# Altium schematic sheet FPGA.SchDoc
size 1188 x 840 mm
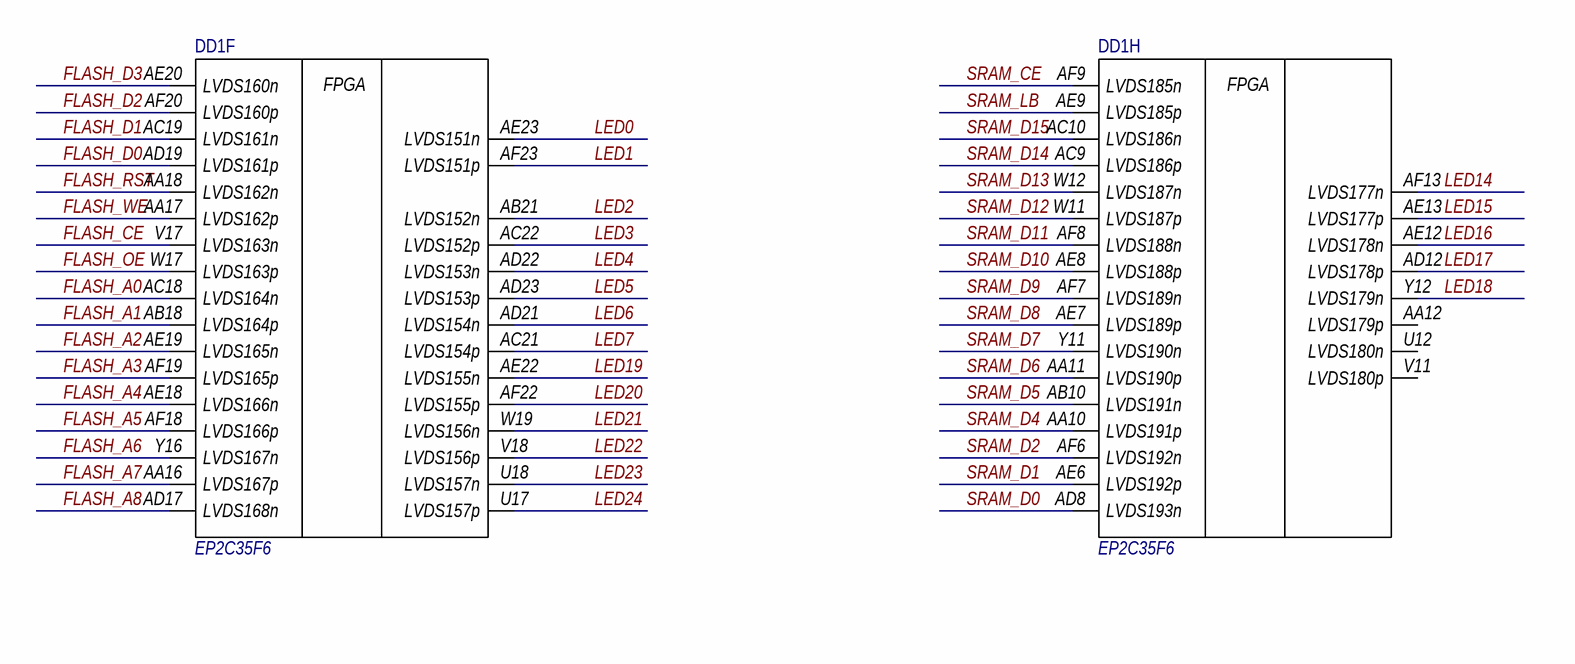
[diagram p0: FPGA.SchDoc, top left]
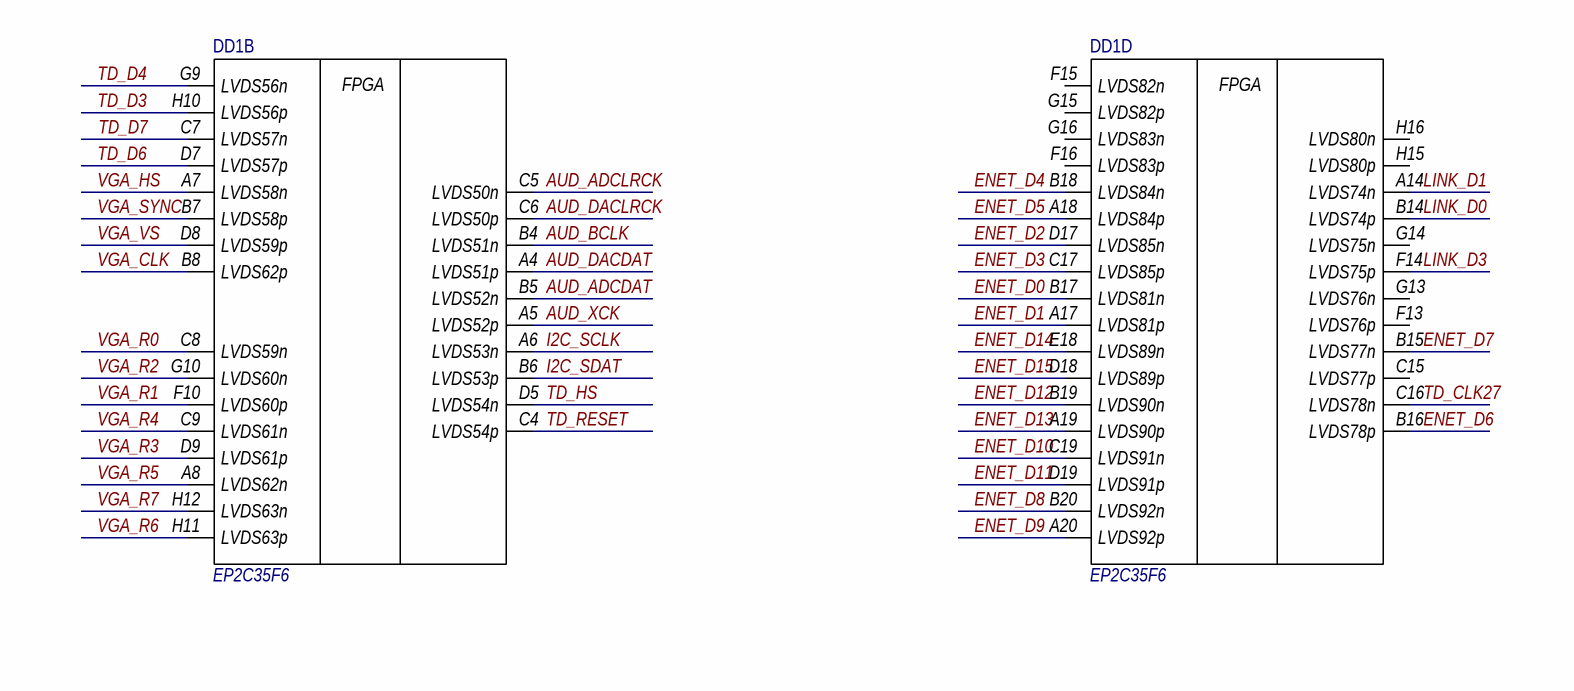
[diagram p1: FPGA.SchDoc, top right]
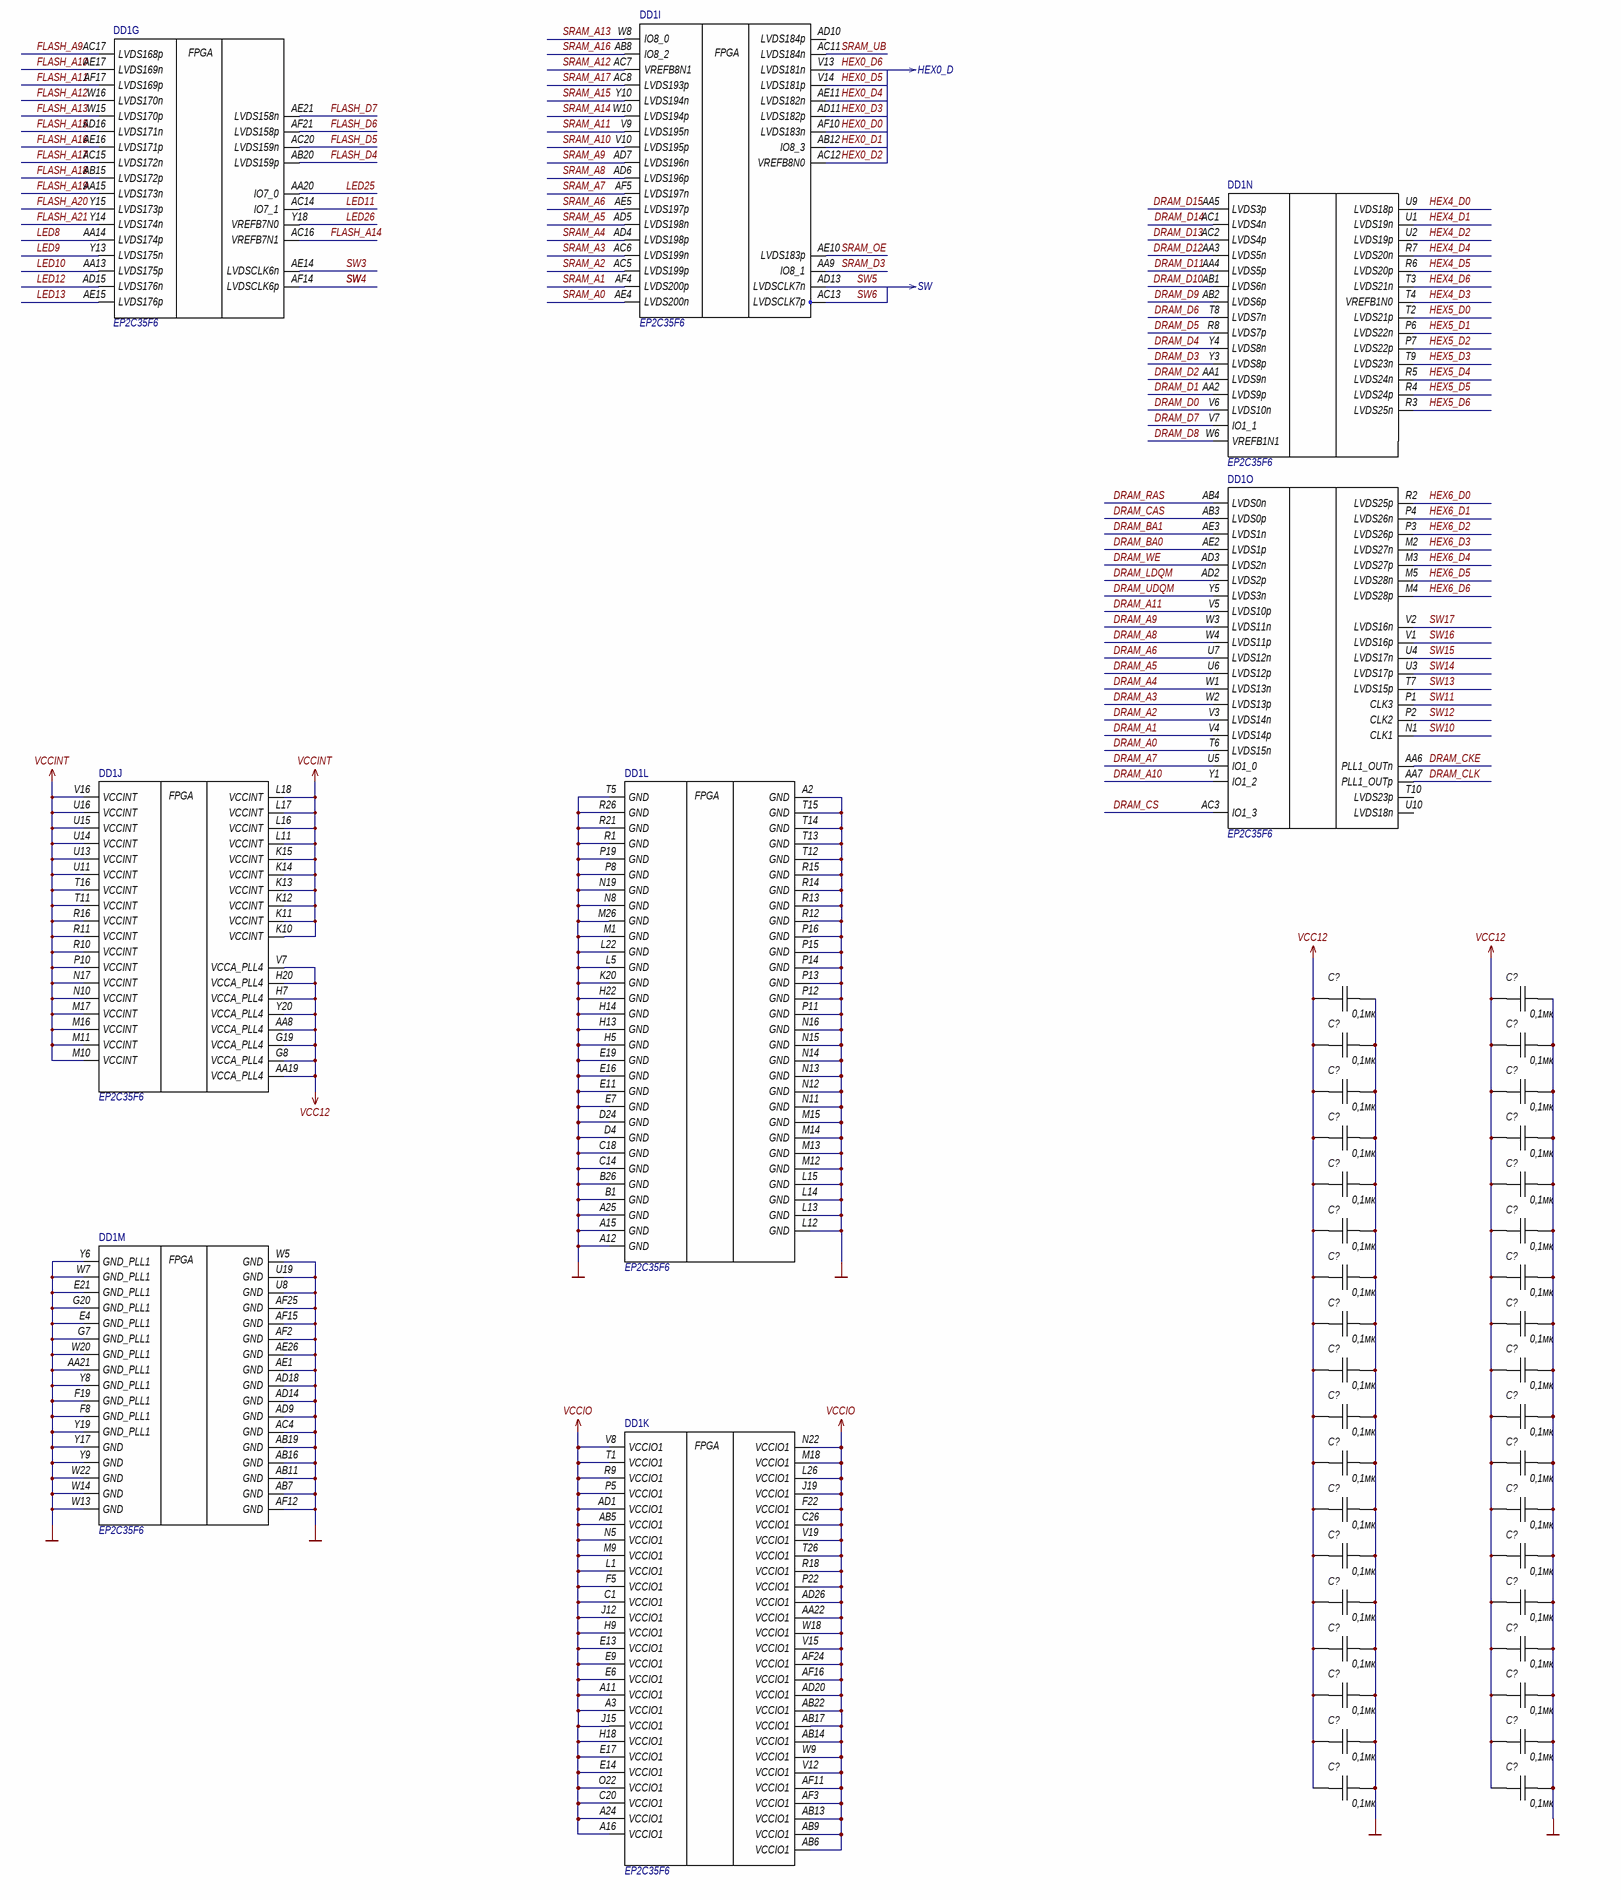
[diagram p2: FPGA.SchDoc, bottom left]
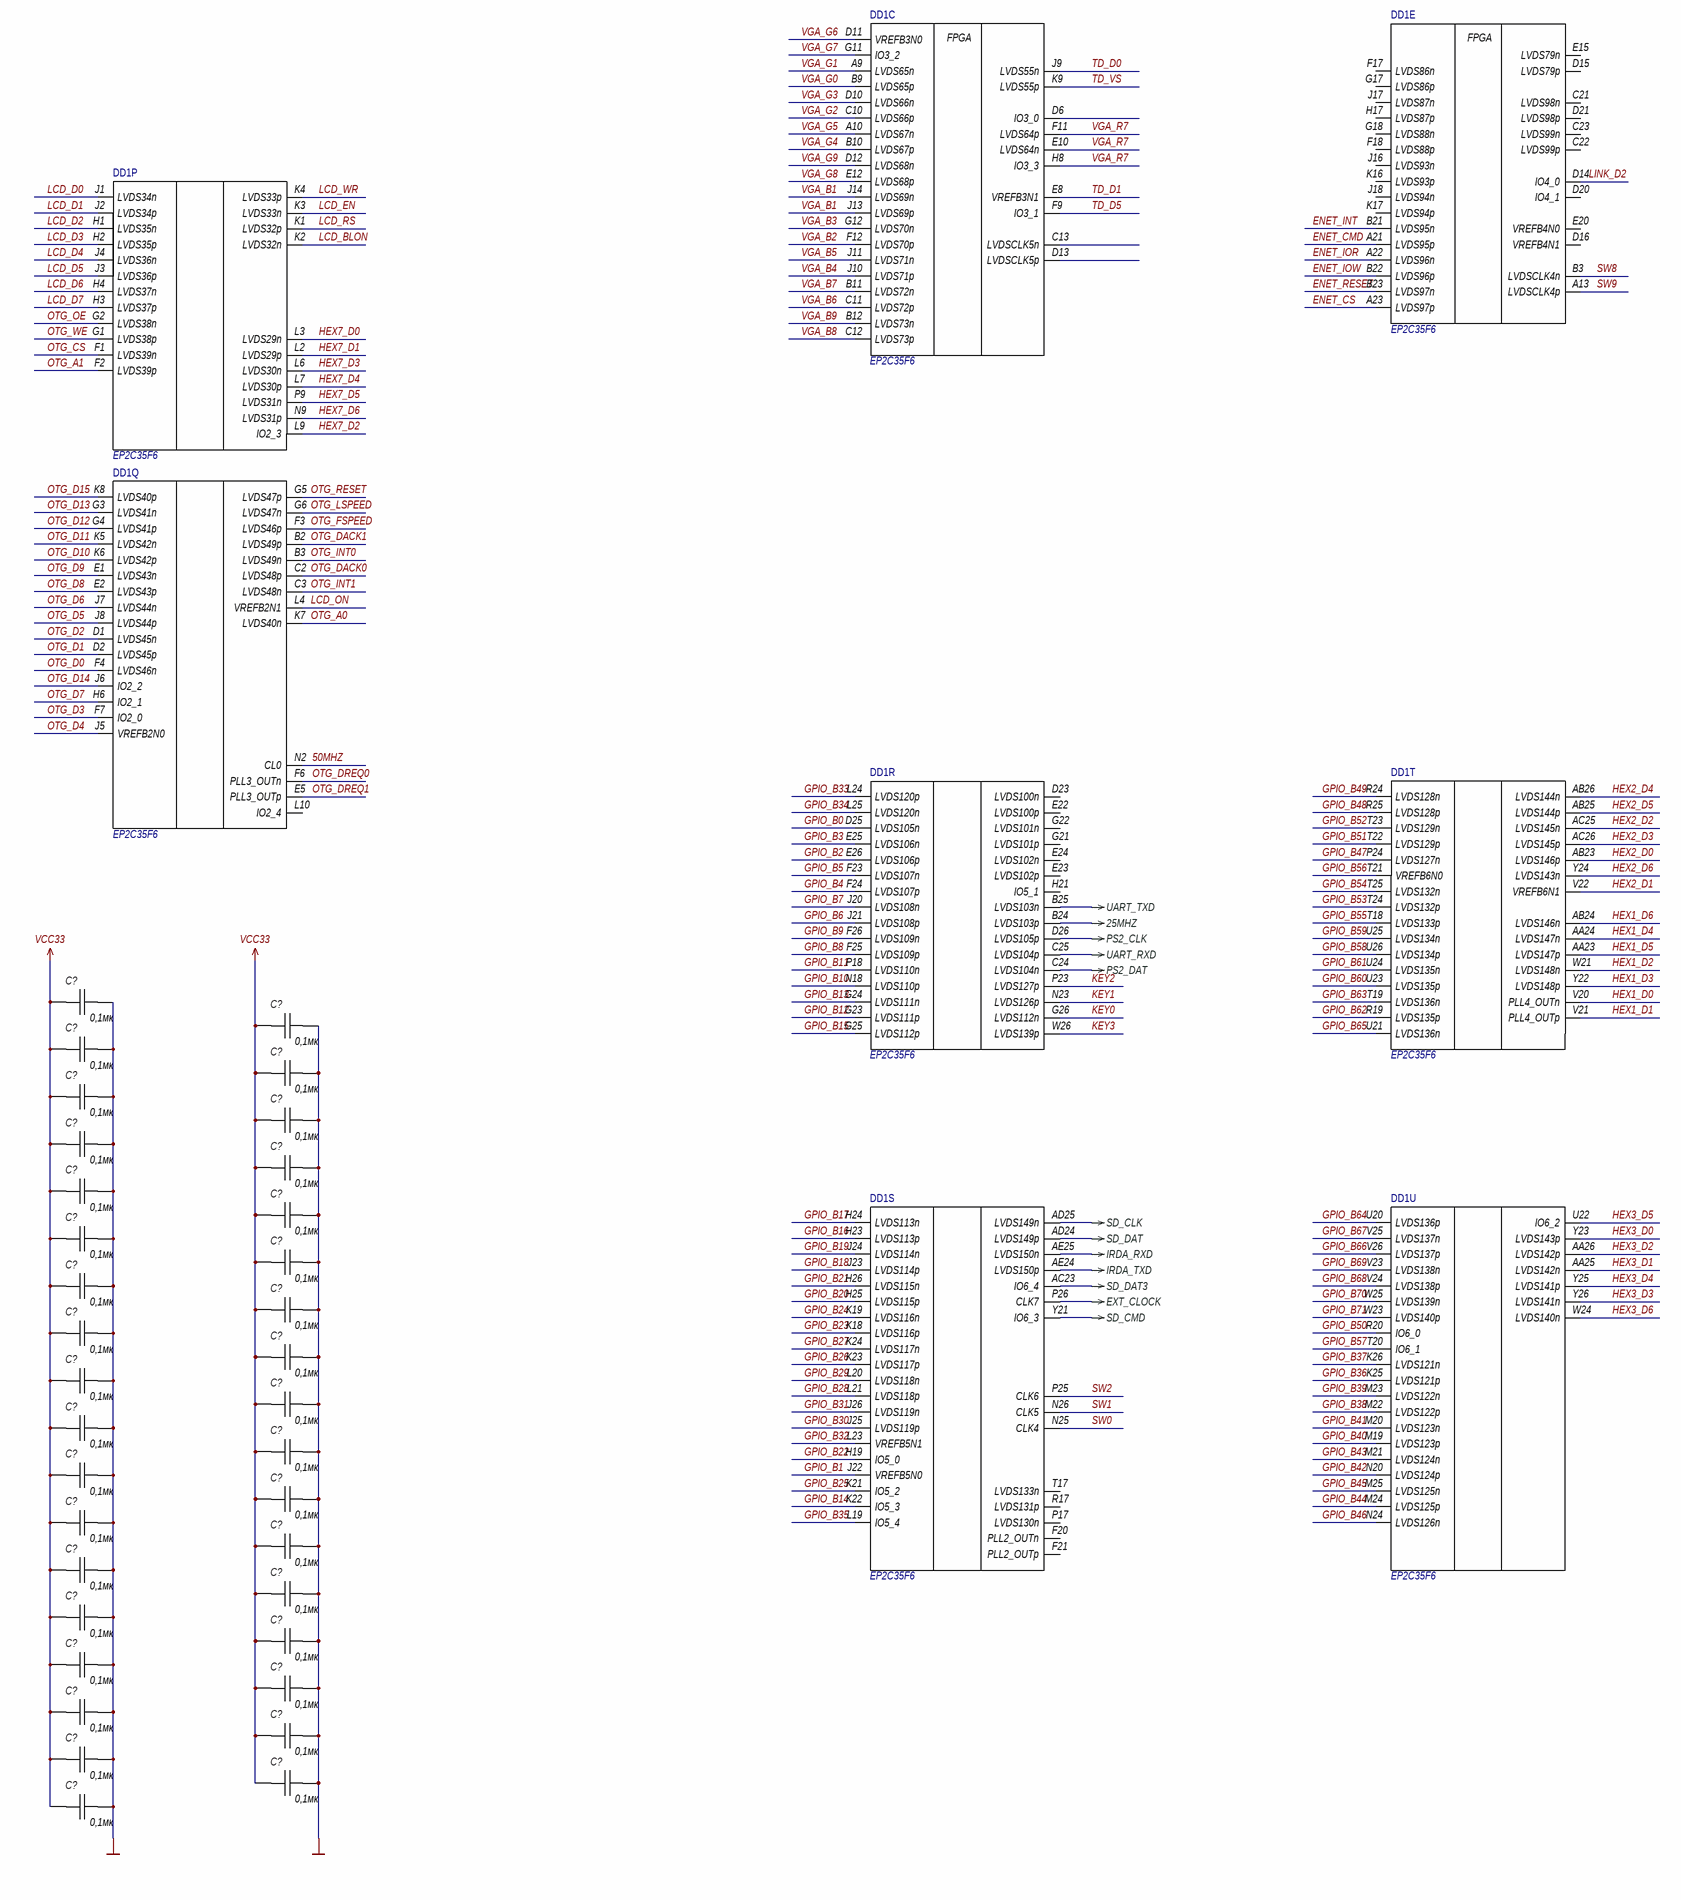
[diagram p3: FPGA.SchDoc, bottom right]

## Parts
(Parts that share a designator on the sheet are numbered #1, #2 ... from top to bottom, then left to right.)
C?#1  0,1мк  [ECPU1C154MA5]
C?#2  0,1мк  [ECPU1C154MA5]
C?#3  0,1мк  [ECPU1C154MA5]
C?#4  0,1мк  [ECPU1C154MA5]
C?#5  0,1мк  [ECPU1C154MA5]
C?#6  0,1мк  [ECPU1C154MA5]
C?#7  0,1мк  [ECPU1C154MA5]
C?#8  0,1мк  [ECPU1C154MA5]
C?#9  0,1мк  [ECPU1C154MA5]
C?#10  0,1мк  [ECPU1C154MA5]
C?#11  0,1мк  [ECPU1C154MA5]
C?#12  0,1мк  [ECPU1C154MA5]
C?#13  0,1мк  [ECPU1C154MA5]
C?#14  0,1мк  [ECPU1C154MA5]
C?#15  0,1мк  [ECPU1C154MA5]
C?#16  0,1мк  [ECPU1C154MA5]
C?#17  0,1мк  [ECPU1C154MA5]
C?#18  0,1мк  [ECPU1C154MA5]
C?#19  0,1мк  [ECPU1C154MA5]
C?#20  0,1мк  [ECPU1C154MA5]
C?#21  0,1мк  [ECPU1C154MA5]
C?#22  0,1мк  [ECPU1C154MA5]
C?#23  0,1мк  [ECPU1C154MA5]
C?#24  0,1мк  [ECPU1C154MA5]
C?#25  0,1мк  [ECPU1C154MA5]
C?#26  0,1мк  [ECPU1C154MA5]
C?#27  0,1мк  [ECPU1C154MA5]
C?#28  0,1мк  [ECPU1C154MA5]
C?#29  0,1мк  [ECPU1C154MA5]
C?#30  0,1мк  [ECPU1C154MA5]
C?#31  0,1мк  [ECPU1C154MA5]
C?#32  0,1мк  [ECPU1C154MA5]
C?#33  0,1мк  [ECPU1C154MA5]
C?#34  0,1мк  [ECPU1C154MA5]
C?#35  0,1мк  [ECPU1C154MA5]
C?#36  0,1мк  [ECPU1C154MA5]
C?#37  0,1мк  [ECPU1C154MA5]
C?#38  0,1мк  [ECPU1C154MA5]
C?#39  0,1мк  [ECPU1C154MA5]
C?#40  0,1мк  [ECPU1C154MA5]
C?#41  0,1мк  [ECPU1C154MA5]
C?#42  0,1мк  [ECPU1C154MA5]
C?#43  0,1мк  [ECPU1C154MA5]
C?#44  0,1мк  [ECPU1C154MA5]
C?#45  0,1мк  [ECPU1C154MA5]
C?#46  0,1мк  [ECPU1C154MA5]
C?#47  0,1мк  [ECPU1C154MA5]
C?#48  0,1мк  [ECPU1C154MA5]
C?#49  0,1мк  [ECPU1C154MA5]
C?#50  0,1мк  [ECPU1C154MA5]
C?#51  0,1мк  [ECPU1C154MA5]
C?#52  0,1мк  [ECPU1C154MA5]
C?#53  0,1мк  [ECPU1C154MA5]
C?#54  0,1мк  [ECPU1C154MA5]
C?#55  0,1мк  [ECPU1C154MA5]
C?#56  0,1мк  [ECPU1C154MA5]
C?#57  0,1мк  [ECPU1C154MA5]
C?#58  0,1мк  [ECPU1C154MA5]
C?#59  0,1мк  [ECPU1C154MA5]
C?#60  0,1мк  [ECPU1C154MA5]
C?#61  0,1мк  [ECPU1C154MA5]
C?#62  0,1мк  [ECPU1C154MA5]
C?#63  0,1мк  [ECPU1C154MA5]
C?#64  0,1мк  [ECPU1C154MA5]
C?#65  0,1мк  [ECPU1C154MA5]
C?#66  0,1мк  [ECPU1C154MA5]
C?#67  0,1мк  [ECPU1C154MA5]
C?#68  0,1мк  [ECPU1C154MA5]
C?#69  0,1мк  [ECPU1C154MA5]
C?#70  0,1мк  [ECPU1C154MA5]
C?#71  0,1мк  [ECPU1C154MA5]
DD1  EP2C35F6  [BGA672CP100_26X26_2700X2700X240B60N]  (parts B,C,D,E,F,G,H,I,J,K,L,M,N,O,P,Q,R,S,T,U of 21)

## Nets
25MHZ: DD1.B24(LVDS103p)
EXT_CLOCK: DD1.P26(CLK7)
GND: C?#1.2 C?#2.2 C?#3.2 C?#4.2 C?#5.2 C?#6.2 C?#7.2 C?#8.2 C?#9.2 C?#10.2 C?#11.2 C?#12.2 C?#13.2 C?#14.2 C?#15.2 C?#16.2 C?#17.2 C?#18.2 C?#19.2 C?#20.2 C?#21.2 C?#22.2 C?#23.2 C?#24.2 C?#25.2 C?#26.2 C?#27.2 C?#28.2 C?#29.2 C?#30.2 C?#31.2 C?#32.2 C?#33.2 C?#34.2 C?#35.2 C?#36.2 C?#37.2 C?#38.2 C?#39.2 C?#40.2 C?#41.2 C?#42.2 C?#43.2 C?#44.2 C?#45.2 C?#46.2 C?#47.2 C?#48.2 C?#49.2 C?#50.2 C?#51.2 C?#52.2 C?#53.2 C?#54.2 C?#55.2 C?#56.2 C?#57.2 C?#58.2 C?#59.2 C?#60.2 C?#61.2 C?#62.2 C?#63.2 C?#64.2 C?#65.2 C?#66.2 C?#67.2 C?#68.2 C?#69.2 C?#70.2 C?#71.2 DD1.A2(GND) DD1.A12(GND) DD1.A15(GND) DD1.A25(GND) DD1.AA21(GND_PLL1) DD1.AB7(GND) DD1.AB11(GND) DD1.AB16(GND) DD1.AB19(GND) DD1.AC4(GND) DD1.AD9(GND) DD1.AD14(GND) DD1.AD18(GND) DD1.AE1(GND) DD1.AE26(GND) DD1.AF2(GND) DD1.AF12(GND) DD1.AF15(GND) DD1.AF25(GND) DD1.B1(GND) DD1.B26(GND) DD1.C14(GND) DD1.C18(GND) DD1.D4(GND) DD1.D24(GND) DD1.E4(GND_PLL1) DD1.E7(GND) DD1.E11(GND) DD1.E16(GND) DD1.E19(GND) DD1.E21(GND_PLL1) DD1.F8(GND_PLL1) DD1.F19(GND_PLL1) DD1.G7(GND_PLL1) DD1.G20(GND_PLL1) DD1.H5(GND) DD1.H13(GND) DD1.H14(GND) DD1.H22(GND) DD1.K20(GND) DD1.L5(GND) DD1.L12(GND) DD1.L13(GND) DD1.L14(GND) DD1.L15(GND) DD1.L22(GND) DD1.M1(GND) DD1.M12(GND) DD1.M13(GND) DD1.M14(GND) DD1.M15(GND) DD1.M26(GND) DD1.N8(GND) DD1.N11(GND) DD1.N12(GND) DD1.N13(GND) DD1.N14(GND) DD1.N15(GND) DD1.N16(GND) DD1.N19(GND) DD1.P8(GND) DD1.P11(GND) DD1.P12(GND) DD1.P13(GND) DD1.P14(GND) DD1.P15(GND) DD1.P16(GND) DD1.P19(GND) DD1.R1(GND) DD1.R12(GND) DD1.R13(GND) DD1.R14(GND) DD1.R15(GND) DD1.R21(GND) DD1.R26(GND) DD1.T5(GND) DD1.T12(GND) DD1.T13(GND) DD1.T14(GND) DD1.T15(GND) DD1.U8(GND) DD1.U19(GND) DD1.W5(GND) DD1.W7(GND_PLL1) DD1.W13(GND) DD1.W14(GND) DD1.W20(GND_PLL1) DD1.W22(GND) DD1.Y6(GND_PLL1) DD1.Y8(GND_PLL1) DD1.Y9(GND) DD1.Y17(GND) DD1.Y19(GND_PLL1)
IRDA_RXD: DD1.AE25(LVDS150n)
IRDA_TXD: DD1.AE24(LVDS150p)
PS2_CLK: DD1.D26(LVDS105p)
PS2_DAT: DD1.C24(LVDS104n)
SD_CLK: DD1.AD25(LVDS149n)
SD_CMD: DD1.Y21(IO6_3)
SD_DAT: DD1.AD24(LVDS149p)
SD_DAT3: DD1.AC23(IO6_4)
SW: DD1.AF14(LVDSCLK6p)  [also labelled SW4]
UART_RXD: DD1.C25(LVDS104p)
UART_TXD: DD1.B25(LVDS103n)
VCC12: C?#1.1 C?#2.1 C?#5.1 C?#6.1 C?#9.1 C?#10.1 C?#13.1 C?#14.1 C?#17.1 C?#18.1 C?#21.1 C?#22.1 C?#25.1 C?#26.1 C?#29.1 C?#30.1 C?#33.1 C?#34.1 C?#37.1 C?#38.1 C?#41.1 C?#42.1 C?#45.1 C?#46.1 C?#49.1 C?#50.1 C?#53.1 C?#54.1 C?#57.1 C?#58.1 C?#61.1 C?#62.1 C?#65.1 C?#66.1 C?#69.1 C?#70.1 DD1.AA8(VCCA_PLL4) DD1.AA19(VCCA_PLL4) DD1.G8(VCCA_PLL4) DD1.G19(VCCA_PLL4) DD1.H7(VCCA_PLL4) DD1.H20(VCCA_PLL4) DD1.V7(VCCA_PLL4) DD1.Y20(VCCA_PLL4)
VCC33: C?#3.1 C?#4.1 C?#7.1 C?#8.1 C?#11.1 C?#12.1 C?#15.1 C?#16.1 C?#19.1 C?#20.1 C?#23.1 C?#24.1 C?#27.1 C?#28.1 C?#31.1 C?#32.1 C?#35.1 C?#36.1 C?#39.1 C?#40.1 C?#43.1 C?#44.1 C?#47.1 C?#48.1 C?#51.1 C?#52.1 C?#55.1 C?#56.1 C?#59.1 C?#60.1 C?#63.1 C?#64.1 C?#67.1 C?#68.1 C?#71.1
VCCINT: DD1.K10(VCCINT) DD1.K11(VCCINT) DD1.K12(VCCINT) DD1.K13(VCCINT) DD1.K14(VCCINT) DD1.K15(VCCINT) DD1.L11(VCCINT) DD1.L16(VCCINT) DD1.L17(VCCINT) DD1.L18(VCCINT) DD1.M10(VCCINT) DD1.M11(VCCINT) DD1.M16(VCCINT) DD1.M17(VCCINT) DD1.N10(VCCINT) DD1.N17(VCCINT) DD1.P10(VCCINT) DD1.R10(VCCINT) DD1.R11(VCCINT) DD1.R16(VCCINT) DD1.T11(VCCINT) DD1.T16(VCCINT) DD1.U11(VCCINT) DD1.U13(VCCINT) DD1.U14(VCCINT) DD1.U15(VCCINT) DD1.U16(VCCINT) DD1.V16(VCCINT)
VCCIO: DD1.A3(VCCIO1) DD1.A11(VCCIO1) DD1.A16(VCCIO1) DD1.A24(VCCIO1) DD1.AA22(VCCIO1) DD1.AB5(VCCIO1) DD1.AB6(VCCIO1) DD1.AB9(VCCIO1) DD1.AB13(VCCIO1) DD1.AB14(VCCIO1) DD1.AB17(VCCIO1) DD1.AB22(VCCIO1) DD1.AD1(VCCIO1) DD1.AD20(VCCIO1) DD1.AD26(VCCIO1) DD1.AF3(VCCIO1) DD1.AF11(VCCIO1) DD1.AF16(VCCIO1) DD1.AF24(VCCIO1) DD1.C1(VCCIO1) DD1.C20(VCCIO1) DD1.C26(VCCIO1) DD1.E6(VCCIO1) DD1.E9(VCCIO1) DD1.E13(VCCIO1) DD1.E14(VCCIO1) DD1.E17(VCCIO1) DD1.F5(VCCIO1) DD1.F22(VCCIO1) DD1.H9(VCCIO1) DD1.H18(VCCIO1) DD1.J12(VCCIO1) DD1.J15(VCCIO1) DD1.J19(VCCIO1) DD1.L1(VCCIO1) DD1.L26(VCCIO1) DD1.M9(VCCIO1) DD1.M18(VCCIO1) DD1.N5(VCCIO1) DD1.N22(VCCIO1) DD1.O22(VCCIO1) DD1.P5(VCCIO1) DD1.P22(VCCIO1) DD1.R9(VCCIO1) DD1.R18(VCCIO1) DD1.T1(VCCIO1) DD1.T26(VCCIO1) DD1.V8(VCCIO1) DD1.V12(VCCIO1) DD1.V15(VCCIO1) DD1.V19(VCCIO1) DD1.W9(VCCIO1) DD1.W18(VCCIO1)
50MHZ: DD1.N2(CL0)
AUD_ADCDAT: DD1.B5(LVDS52n)
AUD_ADCLRCK: DD1.C5(LVDS50n)
AUD_BCLK: DD1.B4(LVDS51n)
AUD_DACDAT: DD1.A4(LVDS51p)
AUD_DACLRCK: DD1.C6(LVDS50p)
AUD_XCK: DD1.A5(LVDS52p)
DRAM_A0: DD1.T6(LVDS15n)
DRAM_A1: DD1.V4(LVDS14p)
DRAM_A2: DD1.V3(LVDS14n)
DRAM_A3: DD1.W2(LVDS13p)
DRAM_A4: DD1.W1(LVDS13n)
DRAM_A5: DD1.U6(LVDS12p)
DRAM_A6: DD1.U7(LVDS12n)
DRAM_A7: DD1.U5(IO1_0)
DRAM_A8: DD1.W4(LVDS11p)
DRAM_A9: DD1.W3(LVDS11n)
DRAM_A10: DD1.Y1(IO1_2)
DRAM_A11: DD1.V5(LVDS10p)
DRAM_BA0: DD1.AE2(LVDS1p)
DRAM_BA1: DD1.AE3(LVDS1n)
DRAM_CAS: DD1.AB3(LVDS0p)
DRAM_CKE: DD1.AA6(PLL1_OUTn)
DRAM_CLK: DD1.AA7(PLL1_OUTp)
DRAM_CS: DD1.AC3(IO1_3)
DRAM_D0: DD1.V6(LVDS10n)
DRAM_D1: DD1.AA2(LVDS9p)
DRAM_D2: DD1.AA1(LVDS9n)
DRAM_D3: DD1.Y3(LVDS8p)
DRAM_D4: DD1.Y4(LVDS8n)
DRAM_D5: DD1.R8(LVDS7p)
DRAM_D6: DD1.T8(LVDS7n)
DRAM_D7: DD1.V7(IO1_1)
DRAM_D8: DD1.W6(VREFB1N1)
DRAM_D9: DD1.AB2(LVDS6p)
DRAM_D10: DD1.AB1(LVDS6n)
DRAM_D11: DD1.AA4(LVDS5p)
DRAM_D12: DD1.AA3(LVDS5n)
DRAM_D13: DD1.AC2(LVDS4p)
DRAM_D14: DD1.AC1(LVDS4n)
DRAM_D15: DD1.AA5(LVDS3p)
DRAM_LDQM: DD1.AD2(LVDS2p)
DRAM_RAS: DD1.AB4(LVDS0n)
DRAM_UDQM: DD1.Y5(LVDS3n)
DRAM_WE: DD1.AD3(LVDS2n)
ENET_CMD: DD1.A21(LVDS95p)
ENET_CS: DD1.A23(LVDS97p)
ENET_D0: DD1.B17(LVDS81n)
ENET_D1: DD1.A17(LVDS81p)
ENET_D2: DD1.D17(LVDS85n)
ENET_D3: DD1.C17(LVDS85p)
ENET_D4: DD1.B18(LVDS84n)
ENET_D5: DD1.A18(LVDS84p)
ENET_D6: DD1.B16(LVDS78p)
ENET_D7: DD1.B15(LVDS77n)
ENET_D8: DD1.B20(LVDS92n)
ENET_D9: DD1.A20(LVDS92p)
ENET_D10: DD1.C19(LVDS91n)
ENET_D11: DD1.D19(LVDS91p)
ENET_D12: DD1.B19(LVDS90n)
ENET_D13: DD1.A19(LVDS90p)
ENET_D14: DD1.E18(LVDS89n)
ENET_D15: DD1.D18(LVDS89p)
ENET_INT: DD1.B21(LVDS95n)
ENET_IOR: DD1.A22(LVDS96n)
ENET_IOW: DD1.B22(LVDS96p)
ENET_RESET: DD1.B23(LVDS97n)
FLASH_A0: DD1.AC18(LVDS164n)
FLASH_A1: DD1.AB18(LVDS164p)
FLASH_A2: DD1.AE19(LVDS165n)
FLASH_A3: DD1.AF19(LVDS165p)
FLASH_A4: DD1.AE18(LVDS166n)
FLASH_A5: DD1.AF18(LVDS166p)
FLASH_A6: DD1.Y16(LVDS167n)
FLASH_A7: DD1.AA16(LVDS167p)
FLASH_A8: DD1.AD17(LVDS168n)
FLASH_A9: DD1.AC17(LVDS168p)
FLASH_A10: DD1.AE17(LVDS169n)
FLASH_A11: DD1.AF17(LVDS169p)
FLASH_A12: DD1.W16(LVDS170n)
FLASH_A13: DD1.W15(LVDS170p)
FLASH_A14: DD1.AC16(VREFB7N1)
FLASH_A15: DD1.AD16(LVDS171n)
FLASH_A16: DD1.AE16(LVDS171p)
FLASH_A17: DD1.AC15(LVDS172n)
FLASH_A18: DD1.AB15(LVDS172p)
FLASH_A19: DD1.AA15(LVDS173n)
FLASH_A20: DD1.Y15(LVDS173p)
FLASH_A21: DD1.Y14(LVDS174n)
FLASH_CE: DD1.V17(LVDS163n)
FLASH_D0: DD1.AD19(LVDS161p)
FLASH_D1: DD1.AC19(LVDS161n)
FLASH_D2: DD1.AF20(LVDS160p)
FLASH_D3: DD1.AE20(LVDS160n)
FLASH_D4: DD1.AB20(LVDS159p)
FLASH_D5: DD1.AC20(LVDS159n)
FLASH_D6: DD1.AF21(LVDS158p)
FLASH_D7: DD1.AE21(LVDS158n)
FLASH_OE: DD1.W17(LVDS163p)
FLASH_RST: DD1.AA18(LVDS162n)
FLASH_WE: DD1.AA17(LVDS162p)
GPIO_B0: DD1.D25(LVDS105n)
GPIO_B1: DD1.J22(VREFB5N0)
GPIO_B2: DD1.E26(LVDS106p)
GPIO_B3: DD1.E25(LVDS106n)
GPIO_B4: DD1.F24(LVDS107p)
GPIO_B5: DD1.F23(LVDS107n)
GPIO_B6: DD1.J21(LVDS108p)
GPIO_B7: DD1.J20(LVDS108n)
GPIO_B8: DD1.F25(LVDS109p)
GPIO_B9: DD1.F26(LVDS109n)
GPIO_B10: DD1.N18(LVDS110p)
GPIO_B11: DD1.P18(LVDS110n)
GPIO_B12: DD1.G23(LVDS111p)
GPIO_B13: DD1.G24(LVDS111n)
GPIO_B14: DD1.K22(IO5_3)
GPIO_B15: DD1.G25(LVDS112p)
GPIO_B16: DD1.H23(LVDS113p)
GPIO_B17: DD1.H24(LVDS113n)
GPIO_B18: DD1.J23(LVDS114p)
GPIO_B19: DD1.J24(LVDS114n)
GPIO_B20: DD1.H25(LVDS115p)
GPIO_B21: DD1.H26(LVDS115n)
GPIO_B22: DD1.H19(IO5_0)
GPIO_B23: DD1.K18(LVDS116p)
GPIO_B24: DD1.K19(LVDS116n)
GPIO_B25: DD1.K21(IO5_2)
GPIO_B26: DD1.K23(LVDS117p)
GPIO_B27: DD1.K24(LVDS117n)
GPIO_B28: DD1.L21(LVDS118p)
GPIO_B29: DD1.L20(LVDS118n)
GPIO_B30: DD1.J25(LVDS119p)
GPIO_B31: DD1.J26(LVDS119n)
GPIO_B32: DD1.L23(VREFB5N1)
GPIO_B33: DD1.L24(LVDS120p)
GPIO_B34: DD1.L25(LVDS120n)
GPIO_B35: DD1.L19(IO5_4)
GPIO_B36: DD1.K25(LVDS121p)
GPIO_B37: DD1.K26(LVDS121n)
GPIO_B38: DD1.M22(LVDS122p)
GPIO_B39: DD1.M23(LVDS122n)
GPIO_B40: DD1.M19(LVDS123p)
GPIO_B41: DD1.M20(LVDS123n)
GPIO_B42: DD1.N20(LVDS124p)
GPIO_B43: DD1.M21(LVDS124n)
GPIO_B44: DD1.M24(LVDS125p)
GPIO_B45: DD1.M25(LVDS125n)
GPIO_B46: DD1.N24(LVDS126n)
GPIO_B47: DD1.P24(LVDS127n)
GPIO_B48: DD1.R25(LVDS128p)
GPIO_B49: DD1.R24(LVDS128n)
GPIO_B50: DD1.R20(IO6_0)
GPIO_B51: DD1.T22(LVDS129p)
GPIO_B52: DD1.T23(LVDS129n)
GPIO_B53: DD1.T24(LVDS132p)
GPIO_B54: DD1.T25(LVDS132n)
GPIO_B55: DD1.T18(LVDS133p)
GPIO_B56: DD1.T21(VREFB6N0)
GPIO_B57: DD1.T20(IO6_1)
GPIO_B58: DD1.U26(LVDS134p)
GPIO_B59: DD1.U25(LVDS134n)
GPIO_B60: DD1.U23(LVDS135p)
GPIO_B61: DD1.U24(LVDS135n)
GPIO_B62: DD1.R19(LVDS135p)
GPIO_B63: DD1.T19(LVDS136n)
GPIO_B64: DD1.U20(LVDS136p)
GPIO_B65: DD1.U21(LVDS136n)
GPIO_B66: DD1.V26(LVDS137p)
GPIO_B67: DD1.V25(LVDS137n)
GPIO_B68: DD1.V24(LVDS138p)
GPIO_B69: DD1.V23(LVDS138n)
GPIO_B70: DD1.W25(LVDS139n)
GPIO_B71: DD1.W23(LVDS140p)
HEX0_D0: DD1.AF10(LVDS183n)
HEX0_D1: DD1.AB12(IO8_3)
HEX0_D2: DD1.AC12(VREFB8N0)
HEX0_D3: DD1.AD11(LVDS182p)
HEX0_D4: DD1.AE11(LVDS182n)
HEX0_D5: DD1.V14(LVDS181p)
HEX0_D6: DD1.V13(LVDS181n)
HEX1_D0: DD1.V20(PLL4_OUTn)
HEX1_D1: DD1.V21(PLL4_OUTp)
HEX1_D2: DD1.W21(LVDS148n)
HEX1_D3: DD1.Y22(LVDS148p)
HEX1_D4: DD1.AA24(LVDS147n)
HEX1_D5: DD1.AA23(LVDS147p)
HEX1_D6: DD1.AB24(LVDS146n)
HEX2_D0: DD1.AB23(LVDS146p)
HEX2_D1: DD1.V22(VREFB6N1)
HEX2_D2: DD1.AC25(LVDS145n)
HEX2_D3: DD1.AC26(LVDS145p)
HEX2_D4: DD1.AB26(LVDS144n)
HEX2_D5: DD1.AB25(LVDS144p)
HEX2_D6: DD1.Y24(LVDS143n)
HEX3_D0: DD1.Y23(LVDS143p)
HEX3_D1: DD1.AA25(LVDS142n)
HEX3_D2: DD1.AA26(LVDS142p)
HEX3_D3: DD1.Y26(LVDS141n)
HEX3_D4: DD1.Y25(LVDS141p)
HEX3_D5: DD1.U22(IO6_2)
HEX3_D6: DD1.W24(LVDS140n)
HEX4_D0: DD1.U9(LVDS18p)
HEX4_D1: DD1.U1(LVDS19n)
HEX4_D2: DD1.U2(LVDS19p)
HEX4_D3: DD1.T4(VREFB1N0)
HEX4_D4: DD1.R7(LVDS20n)
HEX4_D5: DD1.R6(LVDS20p)
HEX4_D6: DD1.T3(LVDS21n)
HEX5_D0: DD1.T2(LVDS21p)
HEX5_D1: DD1.P6(LVDS22n)
HEX5_D2: DD1.P7(LVDS22p)
HEX5_D3: DD1.T9(LVDS23n)
HEX5_D4: DD1.R5(LVDS24n)
HEX5_D5: DD1.R4(LVDS24p)
HEX5_D6: DD1.R3(LVDS25n)
HEX6_D0: DD1.R2(LVDS25p)
HEX6_D1: DD1.P4(LVDS26n)
HEX6_D2: DD1.P3(LVDS26p)
HEX6_D3: DD1.M2(LVDS27n)
HEX6_D4: DD1.M3(LVDS27p)
HEX6_D5: DD1.M5(LVDS28n)
HEX6_D6: DD1.M4(LVDS28p)
HEX7_D0: DD1.L3(LVDS29n)
HEX7_D1: DD1.L2(LVDS29p)
HEX7_D2: DD1.L9(IO2_3)
HEX7_D3: DD1.L6(LVDS30n)
HEX7_D4: DD1.L7(LVDS30p)
HEX7_D5: DD1.P9(LVDS31n)
HEX7_D6: DD1.N9(LVDS31p)
I2C_SCLK: DD1.A6(LVDS53n)
I2C_SDAT: DD1.B6(LVDS53p)
KEY0: DD1.G26(LVDS112n)
KEY1: DD1.N23(LVDS126p)
KEY2: DD1.P23(LVDS127p)
KEY3: DD1.W26(LVDS139p)
LCD_BLON: DD1.K2(LVDS32n)
LCD_D0: DD1.J1(LVDS34n)
LCD_D1: DD1.J2(LVDS34p)
LCD_D2: DD1.H1(LVDS35n)
LCD_D3: DD1.H2(LVDS35p)
LCD_D4: DD1.J4(LVDS36n)
LCD_D5: DD1.J3(LVDS36p)
LCD_D6: DD1.H4(LVDS37n)
LCD_D7: DD1.H3(LVDS37p)
LCD_EN: DD1.K3(LVDS33n)
LCD_ON: DD1.L4(VREFB2N1)
LCD_RS: DD1.K1(LVDS32p)
LCD_WR: DD1.K4(LVDS33p)
LED0: DD1.AE23(LVDS151n)
LED1: DD1.AF23(LVDS151p)
LED2: DD1.AB21(LVDS152n)
LED3: DD1.AC22(LVDS152p)
LED4: DD1.AD22(LVDS153n)
LED5: DD1.AD23(LVDS153p)
LED6: DD1.AD21(LVDS154n)
LED7: DD1.AC21(LVDS154p)
LED8: DD1.AA14(LVDS174p)
LED9: DD1.Y13(LVDS175n)
LED10: DD1.AA13(LVDS175p)
LED11: DD1.AC14(IO7_1)
LED12: DD1.AD15(LVDS176n)
LED13: DD1.AE15(LVDS176p)
LED14: DD1.AF13(LVDS177n)
LED15: DD1.AE13(LVDS177p)
LED16: DD1.AE12(LVDS178n)
LED17: DD1.AD12(LVDS178p)
LED18: DD1.Y12(LVDS179n)
LED19: DD1.AE22(LVDS155n)
LED20: DD1.AF22(LVDS155p)
LED21: DD1.W19(LVDS156n)
LED22: DD1.V18(LVDS156p)
LED23: DD1.U18(LVDS157n)
LED24: DD1.U17(LVDS157p)
LED25: DD1.AA20(IO7_0)
LED26: DD1.Y18(VREFB7N0)
LINK_D0: DD1.B14(LVDS74p)
LINK_D1: DD1.A14(LVDS74n)
LINK_D2: DD1.D14(IO4_0)
LINK_D3: DD1.F14(LVDS75p)
OTG_A0: DD1.K7(LVDS40n)
OTG_A1: DD1.F2(LVDS39p)
OTG_CS: DD1.F1(LVDS39n)
OTG_D0: DD1.F4(LVDS46n)
OTG_D1: DD1.D2(LVDS45p)
OTG_D2: DD1.D1(LVDS45n)
OTG_D3: DD1.F7(IO2_0)
OTG_D4: DD1.J5(VREFB2N0)
OTG_D5: DD1.J8(LVDS44p)
OTG_D6: DD1.J7(LVDS44n)
OTG_D7: DD1.H6(IO2_1)
OTG_D8: DD1.E2(LVDS43p)
OTG_D9: DD1.E1(LVDS43n)
OTG_D10: DD1.K6(LVDS42p)
OTG_D11: DD1.K5(LVDS42n)
OTG_D12: DD1.G4(LVDS41p)
OTG_D13: DD1.G3(LVDS41n)
OTG_D14: DD1.J6(IO2_2)
OTG_D15: DD1.K8(LVDS40p)
OTG_DACK0: DD1.C2(LVDS48p)
OTG_DACK1: DD1.B2(LVDS49p)
OTG_DREQ0: DD1.F6(PLL3_OUTn)
OTG_DREQ1: DD1.E5(PLL3_OUTp)
OTG_FSPEED: DD1.F3(LVDS46p)
OTG_INT0: DD1.B3(LVDS49n)
OTG_INT1: DD1.C3(LVDS48n)
OTG_LSPEED: DD1.G6(LVDS47n)
OTG_OE: DD1.G2(LVDS38n)
OTG_RESET: DD1.G5(LVDS47p)
OTG_WE: DD1.G1(LVDS38p)
SRAM_A0: DD1.AE4(LVDS200n)
SRAM_A1: DD1.AF4(LVDS200p)
SRAM_A2: DD1.AC5(LVDS199p)
SRAM_A3: DD1.AC6(LVDS199n)
SRAM_A4: DD1.AD4(LVDS198p)
SRAM_A5: DD1.AD5(LVDS198n)
SRAM_A6: DD1.AE5(LVDS197p)
SRAM_A7: DD1.AF5(LVDS197n)
SRAM_A8: DD1.AD6(LVDS196p)
SRAM_A9: DD1.AD7(LVDS196n)
SRAM_A10: DD1.V10(LVDS195p)
SRAM_A11: DD1.V9(LVDS195n)
SRAM_A12: DD1.AC7(VREFB8N1)
SRAM_A13: DD1.W8(IO8_0)
SRAM_A14: DD1.W10(LVDS194p)
SRAM_A15: DD1.Y10(LVDS194n)
SRAM_A16: DD1.AB8(IO8_2)
SRAM_A17: DD1.AC8(LVDS193p)
SRAM_CE: DD1.AF9(LVDS185n)
SRAM_D0: DD1.AD8(LVDS193n)
SRAM_D1: DD1.AE6(LVDS192p)
SRAM_D2: DD1.AF6(LVDS192n)
SRAM_D3: DD1.AA9(IO8_1)
SRAM_D4: DD1.AA10(LVDS191p)
SRAM_D5: DD1.AB10(LVDS191n)
SRAM_D6: DD1.AA11(LVDS190p)
SRAM_D7: DD1.Y11(LVDS190n)
SRAM_D8: DD1.AE7(LVDS189p)
SRAM_D9: DD1.AF7(LVDS189n)
SRAM_D10: DD1.AE8(LVDS188p)
SRAM_D11: DD1.AF8(LVDS188n)
SRAM_D12: DD1.W11(LVDS187p)
SRAM_D13: DD1.W12(LVDS187n)
SRAM_D14: DD1.AC9(LVDS186p)
SRAM_D15: DD1.AC10(LVDS186n)
SRAM_LB: DD1.AE9(LVDS185p)
SRAM_OE: DD1.AE10(LVDS183p)
SRAM_UB: DD1.AC11(LVDS184n)
SW0: DD1.N25(CLK4)
SW1: DD1.N26(CLK5)
SW2: DD1.P25(CLK6)
SW3: DD1.AE14(LVDSCLK6n)
SW5: DD1.AD13(LVDSCLK7n)
SW6: DD1.AC13(LVDSCLK7p)
SW8: DD1.B3(LVDSCLK4n)
SW9: DD1.A13(LVDSCLK4p)
SW10: DD1.N1(CLK1)
SW11: DD1.P1(CLK3)
SW12: DD1.P2(CLK2)
SW13: DD1.T7(LVDS15p)
SW14: DD1.U3(LVDS17p)
SW15: DD1.U4(LVDS17n)
SW16: DD1.V1(LVDS16p)
SW17: DD1.V2(LVDS16n)
TD_CLK27: DD1.C16(LVDS78n)
TD_D0: DD1.J9(LVDS55n)
TD_D1: DD1.E8(VREFB3N1)
TD_D3: DD1.H10(LVDS56p)
TD_D4: DD1.G9(LVDS56n)
TD_D5: DD1.F9(IO3_1)
TD_D6: DD1.D7(LVDS57p)
TD_D7: DD1.C7(LVDS57n)
TD_HS: DD1.D5(LVDS54n)
TD_RESET: DD1.C4(LVDS54p)
TD_VS: DD1.K9(LVDS55p)
VGA_B1: DD1.J13(LVDS69p) DD1.J14(LVDS69n)
VGA_B2: DD1.F12(LVDS70p)
VGA_B3: DD1.G12(LVDS70n)
VGA_B4: DD1.J10(LVDS71p)
VGA_B5: DD1.J11(LVDS71n)
VGA_B6: DD1.C11(LVDS72p)
VGA_B7: DD1.B11(LVDS72n)
VGA_B8: DD1.C12(LVDS73p)
VGA_B9: DD1.B12(LVDS73n)
VGA_CLK: DD1.B8(LVDS62p)
VGA_G0: DD1.B9(LVDS65p)
VGA_G1: DD1.A9(LVDS65n)
VGA_G2: DD1.C10(LVDS66p)
VGA_G3: DD1.D10(LVDS66n)
VGA_G4: DD1.B10(LVDS67p)
VGA_G5: DD1.A10(LVDS67n)
VGA_G6: DD1.D11(VREFB3N0)
VGA_G7: DD1.G11(IO3_2)
VGA_G8: DD1.E12(LVDS68p)
VGA_G9: DD1.D12(LVDS68n)
VGA_HS: DD1.A7(LVDS58n)
VGA_R0: DD1.C8(LVDS59n)
VGA_R1: DD1.F10(LVDS60p)
VGA_R2: DD1.G10(LVDS60n)
VGA_R3: DD1.D9(LVDS61p)
VGA_R4: DD1.C9(LVDS61n)
VGA_R5: DD1.A8(LVDS62n)
VGA_R6: DD1.H11(LVDS63p)
VGA_R7: DD1.E10(LVDS64n) DD1.F11(LVDS64p) DD1.H8(IO3_3) DD1.H12(LVDS63n)
VGA_SYNC: DD1.B7(LVDS58p)
VGA_VS: DD1.D8(LVDS59p)

Not connected (* = marked no-connect by the designer): DD1 AA12(LVDS179p) AD10(LVDS184p) C13(LVDSCLK5n) C21(LVDS98n) C22(LVDS99p) C23(LVDS99n) D6(IO3_0) D13(LVDSCLK5p) D15(LVDS79p) D16(VREFB4N1) D20(IO4_1) D21(LVDS98p) D23(LVDS100n) E15(LVDS79n) E20(VREFB4N0) E22(LVDS100p) E23(LVDS102p) E24(LVDS102n) F13(LVDS76p) F15(LVDS82n) F16(LVDS83p) F17(LVDS86n) F18(LVDS88p) F20(PLL2_OUTn) F21(PLL2_OUTp) G13(LVDS76n) G14(LVDS75n) G15(LVDS82p) G16(LVDS83n) G17(LVDS86p) G18(LVDS88n) G21(LVDS101p) G22(LVDS101n) H15(LVDS80p) H16(LVDS80n) H17(LVDS87p) H21(IO5_1) J16(LVDS93n) J17(LVDS87n) J18(LVDS94n) K16(LVDS93p) K17(LVDS94p) L10(IO2_4) P17(LVDS130n) R17(LVDS131p) T10(LVDS23p) T17(LVDS133n) U10(LVDS18n) U12(LVDS180n) V11(LVDS180p) С15(LVDS77p)

## Notes on the sheet
- Labels drawn without touching a wire or pin: HEX0_D, SW
- Перв. примен.
- Справ. №
- Подп. и дата
- Инв. № дубл.
- Взам. инв. №
- Разраб.
- Изм.
- Лист
- № докум.
- Подп.
- Дата
- Лит.
- Масса
- Масштаб
- Пров.
- Т. контр.
- Листов
- Инв. № подл.
- Н. контр.
- Утв.
- Копировал
- Формат А0
- (in symbol PLIS, part B) FPGA
- (in symbol PLIS, part C) FPGA
- (in symbol PLIS, part D) FPGA
- (in symbol PLIS, part E) FPGA
- (in symbol PLIS, part F) FPGA
- (in symbol PLIS, part G) FPGA
- (in symbol PLIS, part H) FPGA
- (in symbol PLIS, part I) FPGA
- (in symbol PLIS, part J) FPGA
- (in symbol PLIS, part K) FPGA
- (in symbol PLIS, part L) FPGA
- (in symbol PLIS, part M) FPGA

## Library data of the parts
C?#1-C?#71 = Capacitor_0.1u: ValueType: Конденсатор; Value: 0,1мк; Tolerance: *; URL: *; Temp: *; Case: *; ValueManufacturer: *; ValueManufacturerPartNumber: *; ValueDescription: *; Dielectric: *; ESR: *; Voltage: *
DD1 = PLIS